# EasyEDA Pro project hardware.eprj, schematic tc264
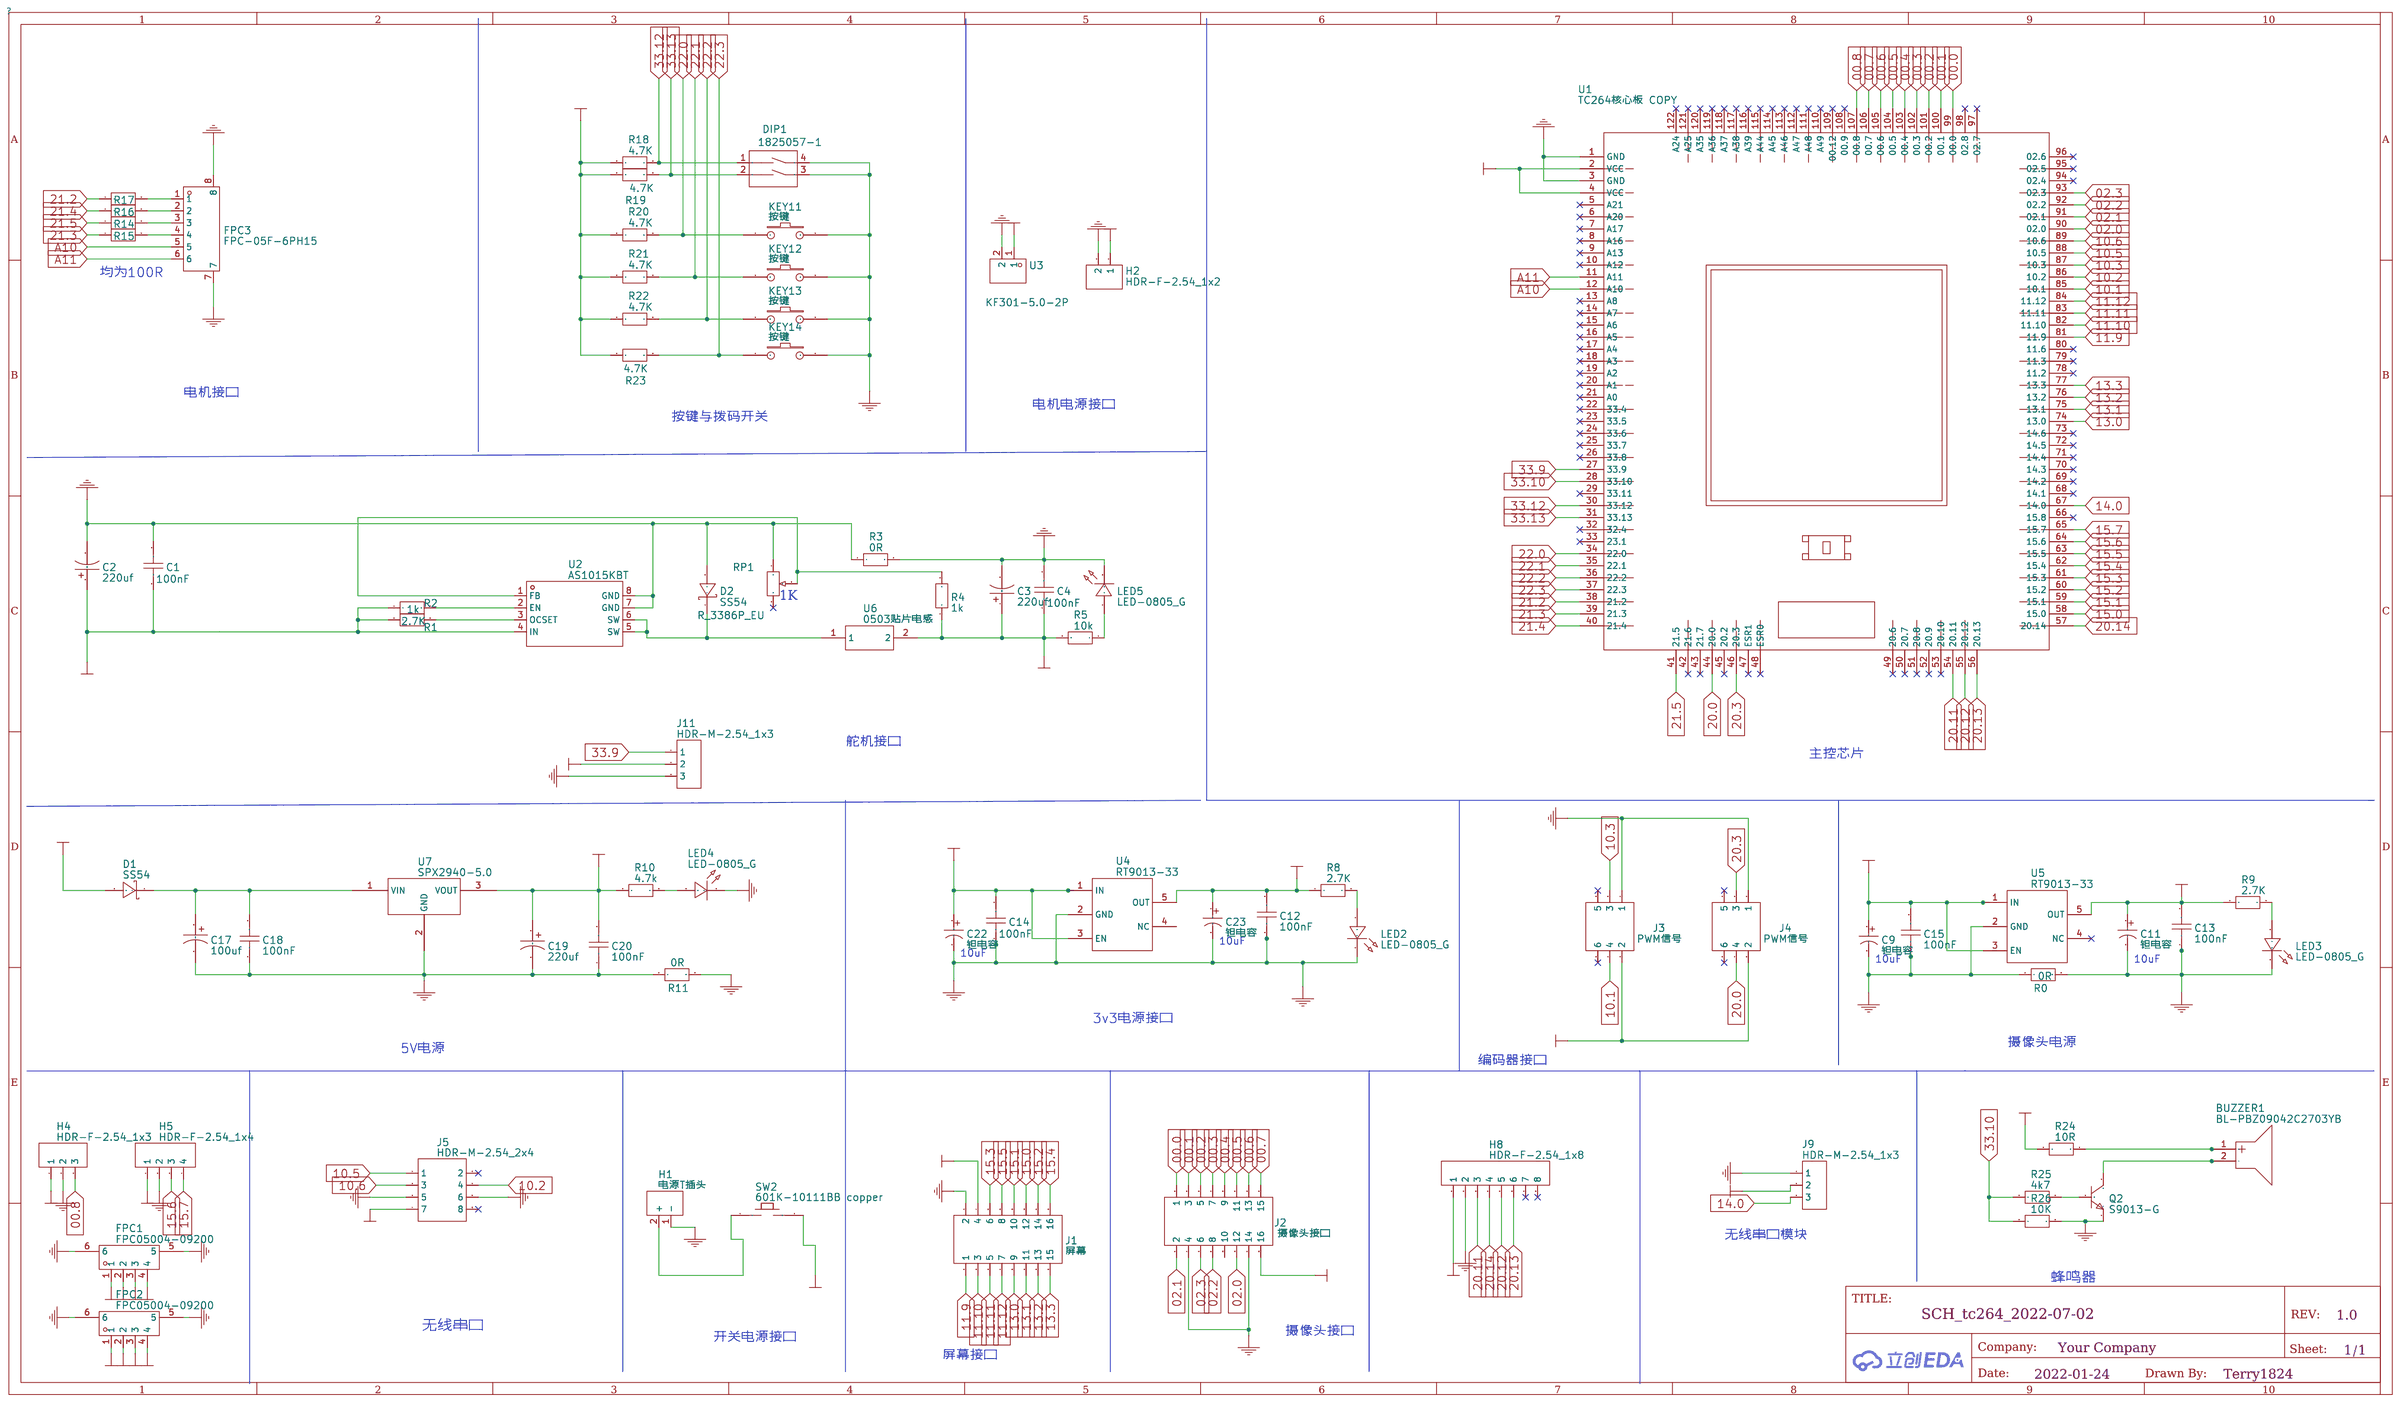
[diagram p6: schematic sheet]

## Parts
BUZZER1  BL-PBZ09042C2703YB  [BUZ-TH_BD9.0-P4.00-D0.6-FD]
C1  100nF  [C0805]
C2  220uf  [CAP-D6.3×F2.5]
C3  220uf  [CAP-D6.3×F2.5]
C4  100nF  [C0805]
C9  钽电容  [CAP-SMD_L3.2-W1.6-RD-1]
C11  钽电容  [CAP-SMD_L3.2-W1.6-RD-1]
C12  100nF  [C0805]
C13  100nF  [C0805]
C14  100nF  [C0805]
C15  100nF  [C0805]
C17  100uf  [CAP-D6.3×F2.5]
C18  100nF  [C0805]
C19  220uf  [CAP-D6.3×F2.5]
C20  100nF  [C0805]
C22  钽电容  [CAP-SMD_L3.2-W1.6-RD-1]
C23  钽电容  [CAP-SMD_L3.2-W1.6-RD-1]
D1  SS54  [SS54]
D2  SS54  [SS54]
DIP1  1825057-1  [SW-TH_1825057-1]
FPC1  FPC05004-09200  [FPC-SMD_FPC05004-09200]
FPC2  FPC05004-09200  [FPC-SMD_FPC05004-09200]
FPC3  FPC-05F-6PH15  [FPC-SMD_6P-P0.50_XUNPU_FPC-05F-6PH15]
H1  电源T插头  [电源T插口]
H2  HDR-F-2.54_1x2  [HDR-F-2.54_1X2]
H4  HDR-F-2.54_1x3  [HDR-F-2.54_1X3]
H5  HDR-F-2.54_1x4  [HDR-F-2.54_1X4]
H8  HDR-F-2.54_1x8  [HDR-F-2.54_1X8]
J1  屏幕  [HDR-M-2.54_2X8]
J2  摄像头接口  [HDR-M-2.54_2X8]
J3  PWM信号  [HDR-M-2.54_2X3]
J4  PWM信号  [HDR-M-2.54_2X3]
J5  HDR-M-2.54_2x4  [HDR-M-2.54_2X4]
J9  HDR-M-2.54_1x3  [HDR-M-2.54_1X3]
J11  HDR-M-2.54_1x3  [HDR-M-2.54_1X3]
KEY11  按键  [按键]
KEY12  按键  [按键]
KEY13  按键  [按键]
KEY14  按键  [按键]
LED2  LED-0805_G  [LED0805_GREEN]
LED3  LED-0805_G  [LED0805_GREEN]
LED4  LED-0805_G  [LED0805_GREEN]
LED5  LED-0805_G  [LED0805_GREEN]
Q2  S9013-G  [SOT-23-3_L2.9-W1.3-P1.90-LS2.4-BR]
R0  0R  [R0805]
R1  2.7K  [R0805]
R2  1k  [R0805]
R3  0R  [R0805]
R4  1k  [R0805]
R5  10k  [R0805]
R8  2.7K  [R0805]
R9  2.7K  [R0805]
R10  4.7k  [R0805]
R11  0R  [R0805]
R14  100  [R0805]
R15  100  [R0805]
R16  100  [R0805]
R17  100  [R0805]
R18  4.7K  [R0805]
R19  4.7K  [R0805]
R20  4.7K  [R0805]
R21  4.7K  [R0805]
R22  4.7K  [R0805]
R23  4.7K  [R0805]
R24  10R  [R0805]
R25  4k7  [R0805]
R26  10K  [R0805]
RP1  R_3386P_EU  [RES-ADJ-TH_3386P]
SW2  601K-10111BB copper  [SW-TH_601K-10111BBCOPPER]
U1  TC264核心板 COPY  [TC264逐飞]
U2  AS1015KBT  [SOP-8_L4.9-W3.9-P1.27-LS6.0-TL]
U3  KF301-5.0-2P  [CONN-TH_P5.00_KF301-5.0-2P]
U4  RT9013-33  [RT9013]
U5  RT9013-33  [RT9013]
U6  0503贴片电感  [0503贴片电感]
U7  SPX2940-5.0  [TO-263-3]

## Library data of the parts
BUZZER1 = BL-PBZ09042C2703YB: link: https://item.szlcsc.com/173200.html; 3DModel: BUZ-TH_D9.0-H5.5-P4.0; Supplier: LCSC; Supplier Part: C187873; Manufacturer: Dongguan Bolin Elec; JLCPCB Part Class: Extended Part
C1 C4 C12-C15 C18 C20 = 100nF: link: https://item.szlcsc.com/373011.html; 3DModel: C0805_L2.0-W1.3-H1.3
C2 C3 C19 = 220uf: 3DModel: CAP-D6.3×H11.2×F2.5
C9 C11 C22 C23 = 钽电容: link: https://atta.szlcsc.com/upload/public/pdf/source/20170919/C118990_1505787086148976735.pdf; Supplier: LCSC; Supplier Part: C425924; Manufacturer: KYOCERA AVX; Manufacturer Part: TCJA106M010R0200; Capacitance: 10uF
C17 = 100uf: 3DModel: CAP-D6.3×H11.2×F2.5
D1 D2 = SS54: 3DModel: SMB_L4.6-W3.6-H2.1-LS5.3
DIP1 = 1825057-1: link: https://item.szlcsc.com/87654.html; 3DModel: SW-TH_L7.1-W7.5-H5.8-P2.54-LS8.4; Supplier: LCSC; Manufacturer: TE Connectivity; Supplier Part: C86477; JLCPCB Part Class: Extended Part
FPC1 FPC2 = FPC05004-09200: link: https://item.szlcsc.com/507785.html; Supplier: LCSC; Supplier Part: C496142; Manufacturer: SHENZHEN ATOM TECH; JLCPCB Part Class: Extended Part
FPC3 = FPC-05F-6PH15: link: https://atta.szlcsc.com/upload/public/pdf/source/20210728/C2856814_C49F3FA2D86614C6CB08249AD960D222.pdf; Supplier: LCSC; Supplier Part: C2856814; Manufacturer: XUNPU(讯普); JLCPCB Part Class: Extended Part
H1 = 电源T插头: Manufacturer: TE Connectivity; Manufacturer Part: 3-644456-2; Supplier Part: C90288
H2 = HDR-F-2.54_1x2: Supplier Part: C49661; Supplier: LCSC
H4 = HDR-F-2.54_1x3: link: https://www.cjt.com/Upload/A2541.pdf; Supplier Part: C146690; Supplier: LCSC
H5 = HDR-F-2.54_1x4: Supplier Part: C225501; Supplier: LCSC
H8 = HDR-F-2.54_1x8: Supplier Part: C225505; Supplier: LCSC
J1 = 屏幕: 3DModel: HDR-M-2.54_2x8; Supplier Part: C68234; Supplier: LCSC
J2 = 摄像头接口: 3DModel: HDR-M-2.54_2x8; Supplier Part: C68234; Supplier: LCSC
J3 J4 = PWM信号: 3DModel: HDR-M-2.54_2x3; Supplier Part: C65114; Supplier: LCSC
J5 = HDR-M-2.54_2x4: Supplier Part: C58363; Supplier: LCSC
J9 J11 = HDR-M-2.54_1x3: Supplier Part: C180248; Supplier: LCSC
KEY11-KEY14 = 按键
LED2-LED5 = LED-0805_G: 3DModel: LED0805_Green; Manufacturer: 国星光电; Manufacturer Part: NCD0805G1; Supplier Part: C84260
Q2 = S9013-G: link: https://www.diodes.com/assets/Package-Files/SOT23.pdf; 3DModel: SOT-23-3P_L2.9-W1.3-H1.0-LS2.4-P0.95; Supplier: LCSC; Supplier Part: C164888; Manufacturer: Changjiang Electronics Tech (CJ); JLCPCB Part Class: Extended Part
R0 R3 R11 = 0R: link: https://item.szlcsc.com/142685.html; 3DModel: R0805_L2.0-W1.3-H0.6
R1 R8 R9 = 2.7K: link: https://item.szlcsc.com/142685.html; 3DModel: R0805_L2.0-W1.3-H0.6
R2 R4 = 1k: link: https://item.szlcsc.com/142685.html; 3DModel: R0805_L2.0-W1.3-H0.6
R5 = 10k: link: https://item.szlcsc.com/142685.html; 3DModel: R0805_L2.0-W1.3-H0.6
R10 = 4.7k: link: https://item.szlcsc.com/142685.html; 3DModel: R0805_L2.0-W1.3-H0.6
R14-R17 = 100: link: https://item.szlcsc.com/142685.html; 3DModel: R0805_L2.0-W1.3-H0.6
R18-R23 = 4.7K: link: https://item.szlcsc.com/142685.html; 3DModel: R0805_L2.0-W1.3-H0.6
R24 = 10R: link: https://item.szlcsc.com/142685.html; 3DModel: R0805_L2.0-W1.3-H0.6
R25 = 4k7: link: https://item.szlcsc.com/142685.html; 3DModel: R0805_L2.0-W1.3-H0.6
R26 = 10K: link: https://item.szlcsc.com/142685.html; 3DModel: R0805_L2.0-W1.3-H0.6
RP1 = R_3386P_EU: link: https://lcsc.com/product-detail/Precision-Potentiometer_Made-in-China-3386P-1-104_C5070.html; Supplier: LCSC; Value(Ω): 10K
SW2 = 601K-10111BB copper: link: https://lcsc.com/product-detail/Rocker-Switches_Made-in-China-C3671_C3671.html; Supplier: LCSC; Manufacturer: ReliaPro; Supplier Part: C3671
U1 = TC264核心板 COPY: Supplier: 逐飞
U2 = AS1015KBT: link: https://item.szlcsc.com/383602.html; 3DModel: SOP-8_L4.9-W3.9-H1.45-LS6.0-P1.27; Supplier: LCSC; Manufacturer: ANISEM; Supplier Part: C51714; JLCPCB Part Class: Extended Part
U3 = KF301-5.0-2P: link: https://item.szlcsc.com/481499.html; Supplier: LCSC; Supplier Part: C474881; Manufacturer: Cixi Kefa Elec; JLCPCB Part Class: Extended Part
U4 U5 = RT9013-33: 3DModel: SOT-23-5_L2.9-W1.6-H1.1-LS2.8-P0.95; Supplier: LCSC; Manufacturer: RICHTEK; Manufacturer Part: RT9013-33GB; image: //image.lceda.cn/szlcsc/C47773.jpg; Supplier Part: C47773; JLCPCB Part Class: Extend; JLCPCB SMD: Yes
U6 = 0503贴片电感
U7 = SPX2940-5.0

## Nets
GND5V: C9.2 C12.1 C14.1 C15.1 C22.2 C23.2 DIP1.3 DIP1.4 FPC1.5 FPC1.6 FPC2.5 FPC2.6 H4.2 H5.2 H8.2 J1.2 J3.1 J4.1 J5.5 J5.6 J9.1 KEY11.2 KEY12.2 KEY13.2 KEY14.2 LED2.2 Q2.2(E) R0.1 R11.2 R26.2 U1.1(GND) U1.3(GND) U4.2(GND) U5.2(GND)
GNDBAT: C1.2 C2.2 C17.2 C18.1 C19.2 C20.1 D2.2(A) FPC3.7 FPC3.8 H1.1(-) H2.2 J11.3 LED4.2 R3.1 R11.1 RP1.1 U2.7(GND) U2.8(GND) U3.2 U7.2(GND)
GNDCAM: C11.2 C13.1 J2.4 J2.14 LED3.2 R0.2
GNDSTEER: C3.2 C4.2 LED5.2 R3.2
VCC3V3: C12.2 C23.1 FPC1.1 FPC1.2 FPC1.3 FPC1.4 FPC2.1 FPC2.2 FPC2.3 FPC2.4 H4.1 H5.1 H8.1 J1.4 J3.2 J4.2 R8.1 R18.1 R19.1 R20.1 R21.1 R22.1 R23.1 R24.1 U1.2(VCC) U1.4(VCC) U4.5(OUT)
VCC5V: C9.1 C14.2 C15.2 C19.1 C20.2 C22.1 J5.7 J9.2 R10.1 U4.1(IN) U4.3(EN) U5.1(IN) U5.3(EN) U7.3(VOUT)
VCCBAT: C1.1 C2.1 D1.2(A) H2.1 R1.1 R2.1 SW2.2 U2.4(IN) U3.1
VCCCAM: C11.1 C13.2 J2.16 R9.1 U5.5(OUT)
VCCSTEER: C3.1 C4.1 J11.2 R4.1 R5.2 U6.2
00.0: J2.1 U1.99(00.0)
00.1: J2.3 U1.100(00.1)
00.2: J2.5 U1.101(00.2)
00.3: J2.7 U1.102(00.3)
00.4: J2.9 U1.103(00.4)
00.5: J2.11 U1.104(00.5)
00.6: J2.13 U1.105(00.6)
00.7: J2.15 U1.106(00.7)
00.8: H4.3 U1.107(00.8)
02.0: J2.12 U1.90(02.0)
02.1: J2.2 U1.91(02.1)
02.2: J2.8 U1.92(02.2)
02.3: J2.6 U1.93(02.3)
10.1: J3.4 U1.85(10.1)
10.2: J5.4 U1.86(10.2)
10.3: J3.3 U1.87(10.3)
10.5: J5.1 U1.88(10.5)
10.6: J5.3 U1.89(10.6)
11.9: J1.1 U1.81(11.9)
11.10: J1.3 U1.82(11.10)
11.11: J1.5 U1.83(11.11)
11.12: J1.7 U1.84(11.12)
13.0: J1.9 U1.74(13.0)
13.1: J1.11 U1.75(13.1)
13.2: J1.13 U1.76(13.2)
13.3: J1.15 U1.77(13.3)
14.0: J9.3 U1.67(14.0)
15.0: J1.12 U1.58(15.0)
15.1: J1.10 U1.59(15.1)
15.2: J1.14 U1.60(15.2)
15.3: J1.6 U1.61(15.3)
15.4: J1.16 U1.62(15.4)
15.5: J1.8 U1.63(15.5)
15.6: H5.3 U1.64(15.6)
15.7: H5.4 U1.65(15.7)
20.0: J4.4 U1.44(20.0)
20.3: J4.3 U1.46(20.3)
20.11: H8.3 U1.54(20.11)
20.12: H8.5 U1.55(20.12)
20.13: H8.6 U1.56(20.13)
20.14: H8.4 U1.57(20.14)
21.2: R17.1 U1.38(21.2)
21.3: R15.1 U1.39(21.3)
21.4: R16.1 U1.40(21.4)
21.5: R14.1 U1.41(21.5)
22.0: KEY11.1 R20.2 U1.34(22.0)
22.1: KEY12.1 R21.2 U1.35(22.1)
22.2: KEY13.1 R22.2 U1.36(22.2)
22.3: KEY14.1 R23.2 U1.37(22.3)
33.9: J11.1 U1.27(33.9)
33.10: R25.1 R26.1 U1.28(33.10)
33.12: DIP1.1 R18.2 U1.30(33.12)
33.13: DIP1.2 R19.2 U1.31(33.13)
A10: FPC3.5 U1.12(A10)
A11: FPC3.6 U1.11(A11)
BUZZER1_1: BUZZER1.1(+) R24.2
BUZZER1_2: BUZZER1.2(-) Q2.3(C)
FPC3_1: FPC3.1 R17.2
FPC3_2: FPC3.2 R16.2
FPC3_3: FPC3.3 R14.2
FPC3_4: FPC3.4 R15.2
H1_2: H1.2(+) SW2.1
LED3_1: LED3.1 R9.2
LED5_1: LED5.1 R5.1
R8_2: LED2.1 R8.2
R10_2: LED4.1 R10.2
R25_2: Q2.1(B) R25.2
U2_1: R4.2 RP1.2 U2.1(FB)
U2_2: R2.2 U2.2(EN)
U2_3: R1.2 U2.3(OCSET)
U2_5: D2.1(K) U2.5(SW) U2.6(SW) U6.1
U7_1: C17.1 C18.2 D1.1(K) U7.1(VIN)

Not connected (* = marked no-connect by the designer): H8 7* 8*; J2 10; J3 5* 6*; J4 5* 6*; J5 2* 8*; RP1 3*; U1 5(A21)* 6(A20)* 7(A17)* 8(A16)* 9(A13)* 10(A12)* 13(A8)* 14(A7)* 15(A6)* 16(A5)* 17(A4)* 18(A3)* 19(A2)* 20(A1)* 21(A0)* 22(33.4)* 23(33.5)* 24(33.6)* 25(33.7)* 26(33.8)* 29(33.11)* 32(32.4)* 33(23.1)* 42(21.6)* 43(21.7)* 45(20.2)* 47(ESR1)* 48(ESR0)* 49(20.6)* 50(20.7)* 51(20.8)* 52(20.9)* 53(20.10)* 66(15.8)* 68(14.1)* 69(14.2)* 70(14.3)* 71(14.4)* 72(14.5)* 73(14.6)* 78(11.2)* 79(11.3)* 80(11.6)* 94(02.4)* 95(02.5)* 96(02.6)* 97(02.7)* 98(02.8)* 108(00.9)* 109(00.12)* 110(A49)* 111(A48)* 112(A47)* 113(A46)* 114(A45)* 115(A44)* 116(A39)* 117(A38)* 118(A37)* 119(A36)* 120(A35)* 121(A25)* 122(A24)*; U4 4(NC); U5 4(NC)*

## Notes on the sheet
- 均为100R
- 电机接口
- 电机电源接口
- 按键与拨码开关
- 1K
- 舵机接口
- 主控芯片
- 10uF
- 10uF
- 10uF
- 10uF
- 3v3电源接口
- 5V电源
- 摄像头电源
- 编码器接口
- 无线串口模块
- 蜂鸣器
- 无线串口
- 摄像头接口
- 开关电源接口
- 屏幕接口
